# Altium schematic sheet syspcb.SchDoc: System Debugging PCB
size A4; DrawnBy: Lorna Lan; Organization: UTAT SS; DocumentNumber: SD01; Revision: 3; SheetNumber: 1; SheetTotal: 1
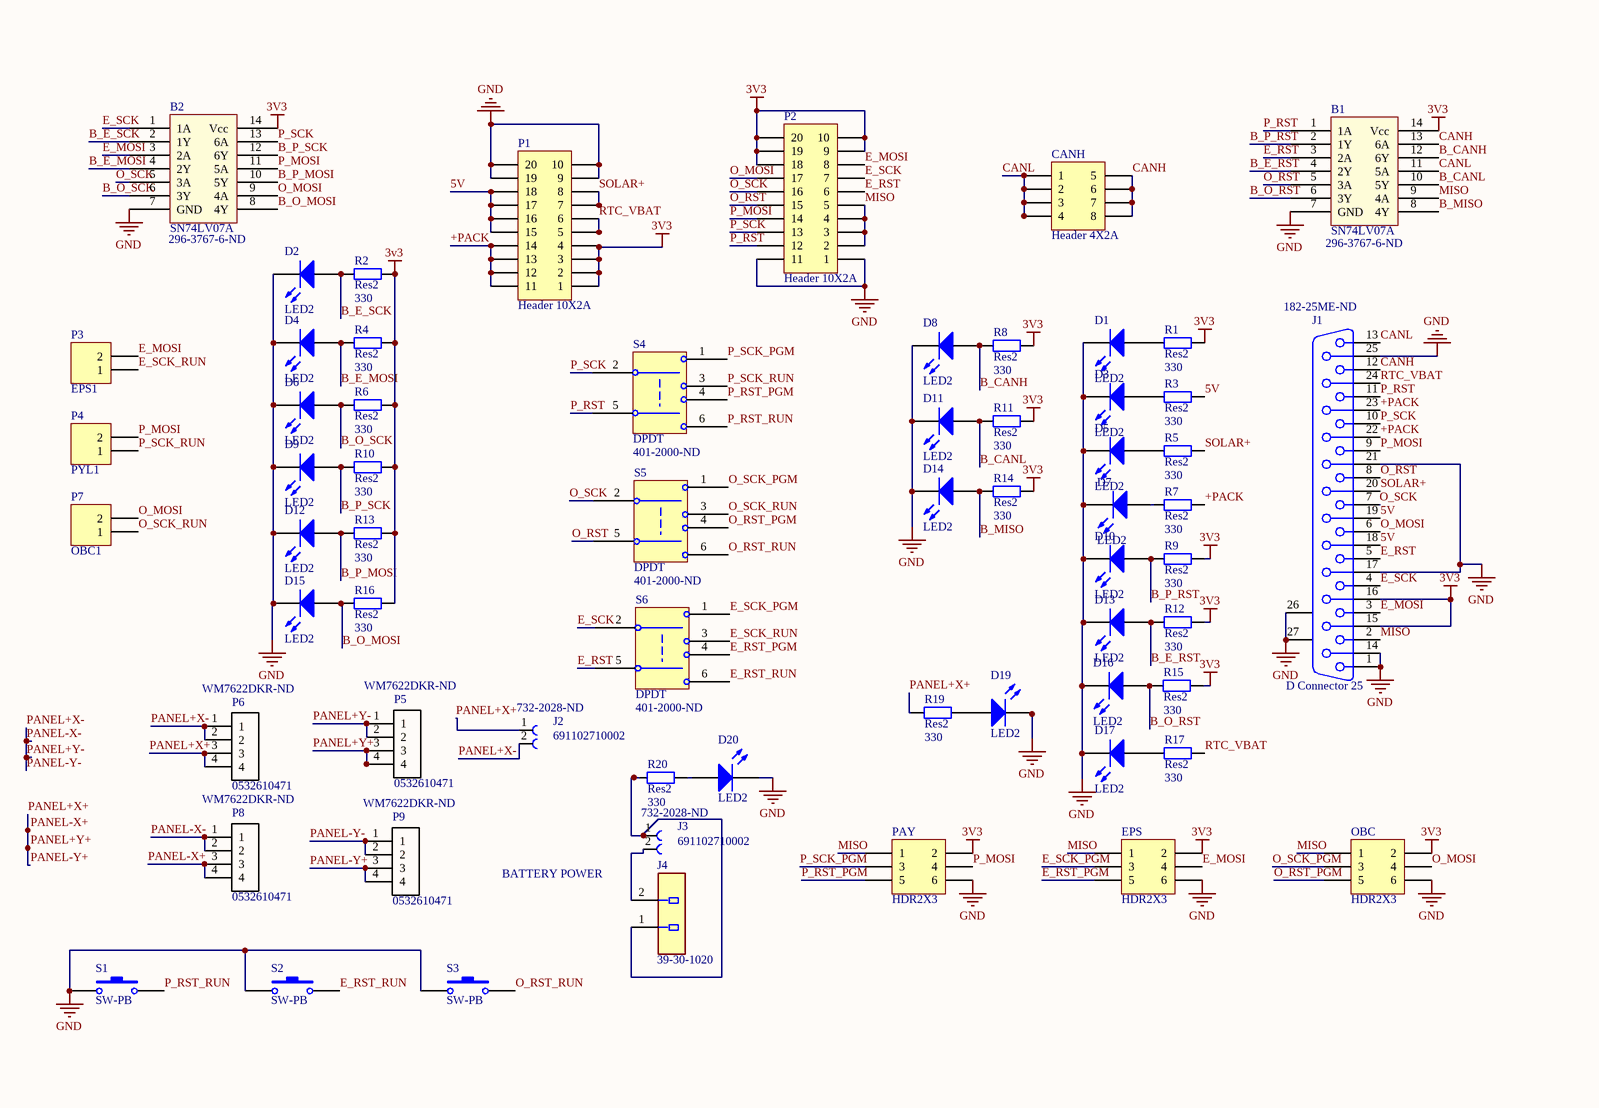
[diagram p0: syspcb.SchDoc, bottom column 3 of 4]

## Parts
B1  SN74LV07A  Supplier Part Number 1: 296-3767-6-ND  [SOIC127P600X175-14N]
B2  SN74LV07A  Supplier Part Number 1: 296-3767-6-ND  [SOIC127P600X175-14N]
CANH  Header 4X2A  [HDR2X4_CEN]
D1  LED2  [0603-LED]
D2  LED2  [0603-LED]
D3  LED2  [0603-LED]
D4  LED2  [0603-LED]
D5  LED2  [0603-LED]
D6  LED2  [0603-LED]
D7  LED2  [0603-LED]
D8  LED2  [0603-LED]
D9  LED2  [0603-LED]
D10  LED2  [0603-LED]
D11  LED2  [0603-LED]
D12  LED2  [0603-LED]
D13  LED2  [0603-LED]
D14  LED2  [0603-LED]
D15  LED2  [0603-LED]
D16  LED2  [0603-LED]
D17  LED2  [0603-LED]
D19  LED2  [0603-LED]
D20  LED2  [0603-LED]
EPS  HDR2X3  [HDR2X3]
J1  D Connector 25  Supplier Part Number 1: 182-25ME-ND  [DSUB1.385-2H25A]
J2  691102710002  Supplier Part Number 1: 732-2028-ND  [691102710002]
J3  691102710002  Supplier Part Number 1: 732-2028-ND  [691102710002]
J4  Part Number: 39-30-1020  [Molex_39-30-1020_0]  (hidden comment: Conn_Molex_39-30-1020_eec)
OBC  HDR2X3  [HDR2X3]
P1  Header 10X2A  [HDR2X10_CEN]
P2  Header 10X2A  [HDR2X10_CEN]
P3  EPS1  [HDR1X2]
P4  PYL1  [HDR1X2]
P5  0532610471  Supplier Part Number 1: WM7622DKR-ND  [MOLEX_0532610471]
P6  0532610471  Supplier Part Number 1: WM7622DKR-ND  [MOLEX_0532610471]
P7  OBC1  [HDR1X2]
P8  0532610471  Supplier Part Number 1: WM7622DKR-ND  [MOLEX_0532610471]
P9  0532610471  Supplier Part Number 1: WM7622DKR-ND  [MOLEX_0532610471]
PAY  HDR2X3  [HDR2X3]
R1  Res2  value 330  [J1-0603]
R2  Res2  value 330  [J1-0603]
R3  Res2  value 330  [J1-0603]
R4  Res2  value 330  [J1-0603]
R5  Res2  value 330  [J1-0603]
R6  Res2  value 330  [J1-0603]
R7  Res2  value 330  [J1-0603]
R8  Res2  value 330  [J1-0603]
R9  Res2  value 330  [J1-0603]
R10  Res2  value 330  [J1-0603]
R11  Res2  value 330  [J1-0603]
R12  Res2  value 330  [J1-0603]
R13  Res2  value 330  [J1-0603]
R14  Res2  value 330  [J1-0603]
R15  Res2  value 330  [J1-0603]
R16  Res2  value 330  [J1-0603]
R17  Res2  value 330  [J1-0603]
R19  Res2  value 330  [J1-0603]
R20  Res2  value 330  [J1-0603]
S1  SW-PB  [SW_5-1437565-0]
S2  SW-PB  [SW_5-1437565-0]
S3  SW-PB  [SW_5-1437565-0]
S4  DPDT  Supplier Part Number 1: 401-2000-ND  [JS202011AQN - Slide Switch]
S5  DPDT  Supplier Part Number 1: 401-2000-ND  [JS202011AQN - Slide Switch]
S6  DPDT  Supplier Part Number 1: 401-2000-ND  [JS202011AQN - Slide Switch]

## Nets
3V3: B1.14(Vcc) B2.14(Vcc) EPS.2 J1.15 J1.16 OBC.2 P1.1 P1.2 P1.3 P1.4 P2.9 P2.10 P2.18 P2.19 P2.20 PAY.2 R1.1 R2.1 R4.1 R6.1 R8.1 R9.1 R10.1 R11.1 R12.1 R13.1 R14.1 R15.1 R16.1
GND: B1.7(GND) B2.7(GND) D1.2(K) D2.2(K) D3.2(K) D4.2(K) D5.2(K) D6.2(K) D7.2(K) D8.2(K) D9.2(K) D10.2(K) D11.2(K) D12.2(K) D13.2(K) D14.2(K) D15.2(K) D16.2(K) D17.2(K) D19.2(K) D20.2(K) EPS.6 J1.1 J1.14 J1.17 J1.21 J1.25 J1.26(MH1) J1.27(MH2) OBC.6 P1.9 P1.10 P1.19 P1.20 P2.1 P2.11 PAY.6 S1.1 S2.1 S3.1
5V: J1.18 J1.19 P1.15 P1.16 P1.17 P1.18 R3.1
+PACK: J1.22 J1.23 P1.11 P1.12 P1.13 P1.14 R7.1
B_CANH: B1.12(6Y) D8.1(A) R8.2
B_CANL: B1.10(5Y) D11.1(A) R11.2
B_E_MOSI: B2.4(2Y) D4.1(A) R4.2
B_E_RST: B1.4(2Y) D13.1(A) R12.2
B_E_SCK: B2.2(1Y) D2.1(A) R2.2
B_MISO: B1.8(4Y) D14.1(A) R14.2
B_O_MOSI: B2.8(4Y) D15.1(A) R16.2
B_O_RST: B1.6(3Y) D16.1(A) R15.2
B_O_SCK: B2.6(3Y) D6.1(A) R6.2
B_P_MOSI: B2.10(5Y) D12.1(A) R13.2
B_P_RST: B1.2(1Y) D10.1(A) R9.2
B_P_SCK: B2.12(6Y) D9.1(A) R10.2
CANH: B1.13(6A) CANH.5 CANH.6 CANH.7 CANH.8 J1.12
CANL: B1.11(5A) CANH.1 CANH.2 CANH.3 CANH.4 J1.13
E_MOSI: B2.3(2A) EPS.4 J1.3 P2.8 P3.2
E_RST: B1.3(2A) J1.5 P2.6 S6.5(POLE2)
E_RST_PGM: EPS.5 S6.4(POLE2A)
E_RST_RUN: S2.2 S6.6(POLE2B)
E_SCK: B2.1(1A) J1.4 P2.7 S6.2(POLE1)
E_SCK_PGM: EPS.3 S6.1(POLE1A)
E_SCK_RUN: P3.1 S6.3(POLE1B)
MISO: B1.9(4A) EPS.1 J1.2 OBC.1 P2.2 P2.3 P2.4 P2.5 PAY.1
O_MOSI: B2.9(4A) J1.6 OBC.4 P2.17 P7.2
O_RST: B1.5(3A) J1.8 P2.15 S5.5(POLE2)
O_RST_PGM: OBC.5 S5.4(POLE2A)
O_RST_RUN: S3.2 S5.6(POLE2B)
O_SCK: B2.5(3A) J1.7 P2.16 S5.2(POLE1)
O_SCK_PGM: OBC.3 S5.1(POLE1A)
O_SCK_RUN: P7.1 S5.3(POLE1B)
P_MOSI: B2.11(5A) J1.9 P2.14 P4.2 PAY.4
P_RST: B1.1(1A) J1.11 P2.12 S4.5(POLE2)
P_RST_PGM: PAY.5 S4.4(POLE2A)
P_RST_RUN: S1.2 S4.6(POLE2B)
P_SCK: B2.13(6A) J1.10 P2.13 S4.2(POLE1)
P_SCK_PGM: PAY.3 S4.1(POLE1A)
P_SCK_RUN: P4.1 S4.3(POLE1B)
PANEL+X+: J2.1 P5.3 P5.4 P6.3 P6.4 P8.3 P8.4 P9.3 P9.4 R19.1  [also labelled PANEL+Y+, PANEL-X+, PANEL-Y+]
PANEL+X-: J2.2 P5.1 P5.2 P6.1 P6.2 P8.1 P8.2 P9.1 P9.2  [also labelled PANEL+Y-, PANEL-X-, PANEL-Y-]
RTC_VBAT: J1.24 P1.5 P1.6 R17.1
SOLAR+: J1.20 P1.7 P1.8 R5.1
NetD1_1: D1.1(A) R1.2
NetD3_1: D3.1(A) R3.2
NetD5_1: D5.1(A) R5.2
NetD7_1: D7.1(A) R7.2
NetD17_1: D17.1(A) R17.2
NetD19_1: D19.1(A) R19.2
NetD20_1: D20.1(A) R20.2
NetJ3_1: J3.1 J4.1 R20.1
NetJ3_2: J3.2 J4.2

## Notes on the sheet
- THIS IS NOT A CONTROLLED DRAWING.
- THIS IS A REPRESENTATION OF THE CUSTOMER VIEW MODEL.
- THIS IS NOT THE DOCUMENT OF SALE.
- SEE THE CUSTOMER DRAWING FOR DESIGN PURPOSES.
- BATTERY POWER

## Library data of the parts
CANH = Header 4X2A: Header, 4-Pin, Dual row; LatestRevisionDate: 17-Jul-2002; LatestRevisionNote: Re-released for DXP Platform.; Publisher: Altium Limited
D1-D17 D19 D20 = LED2: Typical RED, GREEN, YELLOW, AMBER GaAs LED; Published: 8-Jun-2000; LatestRevisionDate: 17-Jul-2002; LatestRevisionNote: Re-released for DXP Platform.; PackageVersion: Feb-2002; PackageReference: 3.2X1.6X1.1; Publisher: Altium Limited; PackageDescription: SM LED; 2 Flat Leads
EPS OBC PAY = MHDR2X3: Header, 3-Pin, Dual row; LatestRevisionDate: 17-Jul-2002; LatestRevisionNote: Re-released for DXP Platform.; Publisher: Altium Limited
J1 = D Connector 25: Receptacle Assembly, 25 Position, Right Angle; PackageDocument: U; Positions: 25; Published: 15-Jun-2001; LatestRevisionDate: 17-Jul-2002; LatestRevisionNote: Re-released for DXP Platform.; DatasheetDocument: 19-Mar-1999; PackageReference: 787202; Publisher: Altium Limited; Orientation: Right Angle; Gender: Receptacle; Supplier 1: Digi-Key
J2 J3 = 691102710002: Screw terminal 0.33 mmÂ² Number of pins 2 Wuerth Elektronik Blue 1 pc_s_; MF: Wurth Electronics; Availability: Unavailable; MP: 691102710002; SnapEDA_Link: https://www.snapeda.com/parts/691102710002/Wurth%20Electronics%20Inc./view-part/?ref=snap; Price: None; Package: None; Value: *; Supplier 1: Digi-Key
J4 = Conn_Molex_39-30-1020_eec: CONN HEADER 2POS 4.2MM R/A TIN; Manufacturer: Molex; Approved Alternate Part Number: WM1351-ND; helpURL: https://upverter.com/upn/revision/2b7531b2fb9fee48/; ComponentLink2Description: Datasheet; Temperature: -40°C to +105°C; Package: HDR02; Supplier 2: Mouser; Price: 0.386810002876; Supplier 1: Digi-Key; ComponentLink1URL: https://upverter.com/upn/revision/2b7531b2fb9fee48/; Supplier Part Number 2: 538-39-30-1020; Supplier Part Number 1: WM1351-ND; ComponentLink1Description: Upverter; ComponentLink2URL: http://www.molex.com/pdm_docs/sd/039301020_sd.pdf; RoHS: TRUE; Mouser Part Number: 538-39-30-1020; Temperature Range High: +105°C; Digikey Description: CONN HEADER 2POS 4.2MM R/A TIN; Digikey Part Number: WM1351-ND; Lead Free: yes; Temperature Range Low: -40°C
P1 P2 = Header 10X2A: Header, 10-Pin, Dual row; LatestRevisionDate: 17-Jul-2002; LatestRevisionNote: Re-released for DXP Platform.; Publisher: Altium Limited
P3 P4 P7 = Header 2: Header, 2-Pin; LatestRevisionDate: 17-Jul-2002; LatestRevisionNote: Re-released for DXP Platform.; Publisher: Altium Limited
P5 P6 P8 P9 = 0532610471: Conn Shrouded Header HDR 4 POS 1.25mm Solder RA SMD PicoBladeâ„¢ Embossed T/R; MF: Molex, LLC; Availability: Unavailable; MP: 0532610471; SnapEDA_Link: https://www.snapeda.com/parts/0532610471/Molex%2C%20LLC/view-part/?ref=snap; Price: None; Package: None; Value: *; Supplier 1: Digi-Key
R1-R17 R19 R20 = Res2: Resistor; Published: 8-Jun-2000; LatestRevisionDate: 17-Jul-2002; LatestRevisionNote: Re-released for DXP Platform.; PackageReference: AXIAL-0.4; Publisher: Altium Limited; PackageDescription: Axial Device, Thru-Hole; 2 Leads; 0.4 in Pin Spacing; Supplier 1: Digi-Key
S1-S3 = SW-PB: Switch; Published: 24-Mar-1999; LatestRevisionDate: 17-Jul-2002; LatestRevisionNote: Re-released for DXP Platform.; PackageReference: SPST-2; Publisher: Altium Limited; PackageDescription: Switch; 2 Leads
S4-S6 = DPDT Switch: DPDT Switch, customized for the pinout of the JS202011AQN switch.; Supplier 1: Digi-Key
B1 B2 = SN74LV07A: Supplier 1: Digi-Key